# EasyEDA Pro project BCI_nikki_corp_ver_1.0.eprj, board BCI_Board (continued)
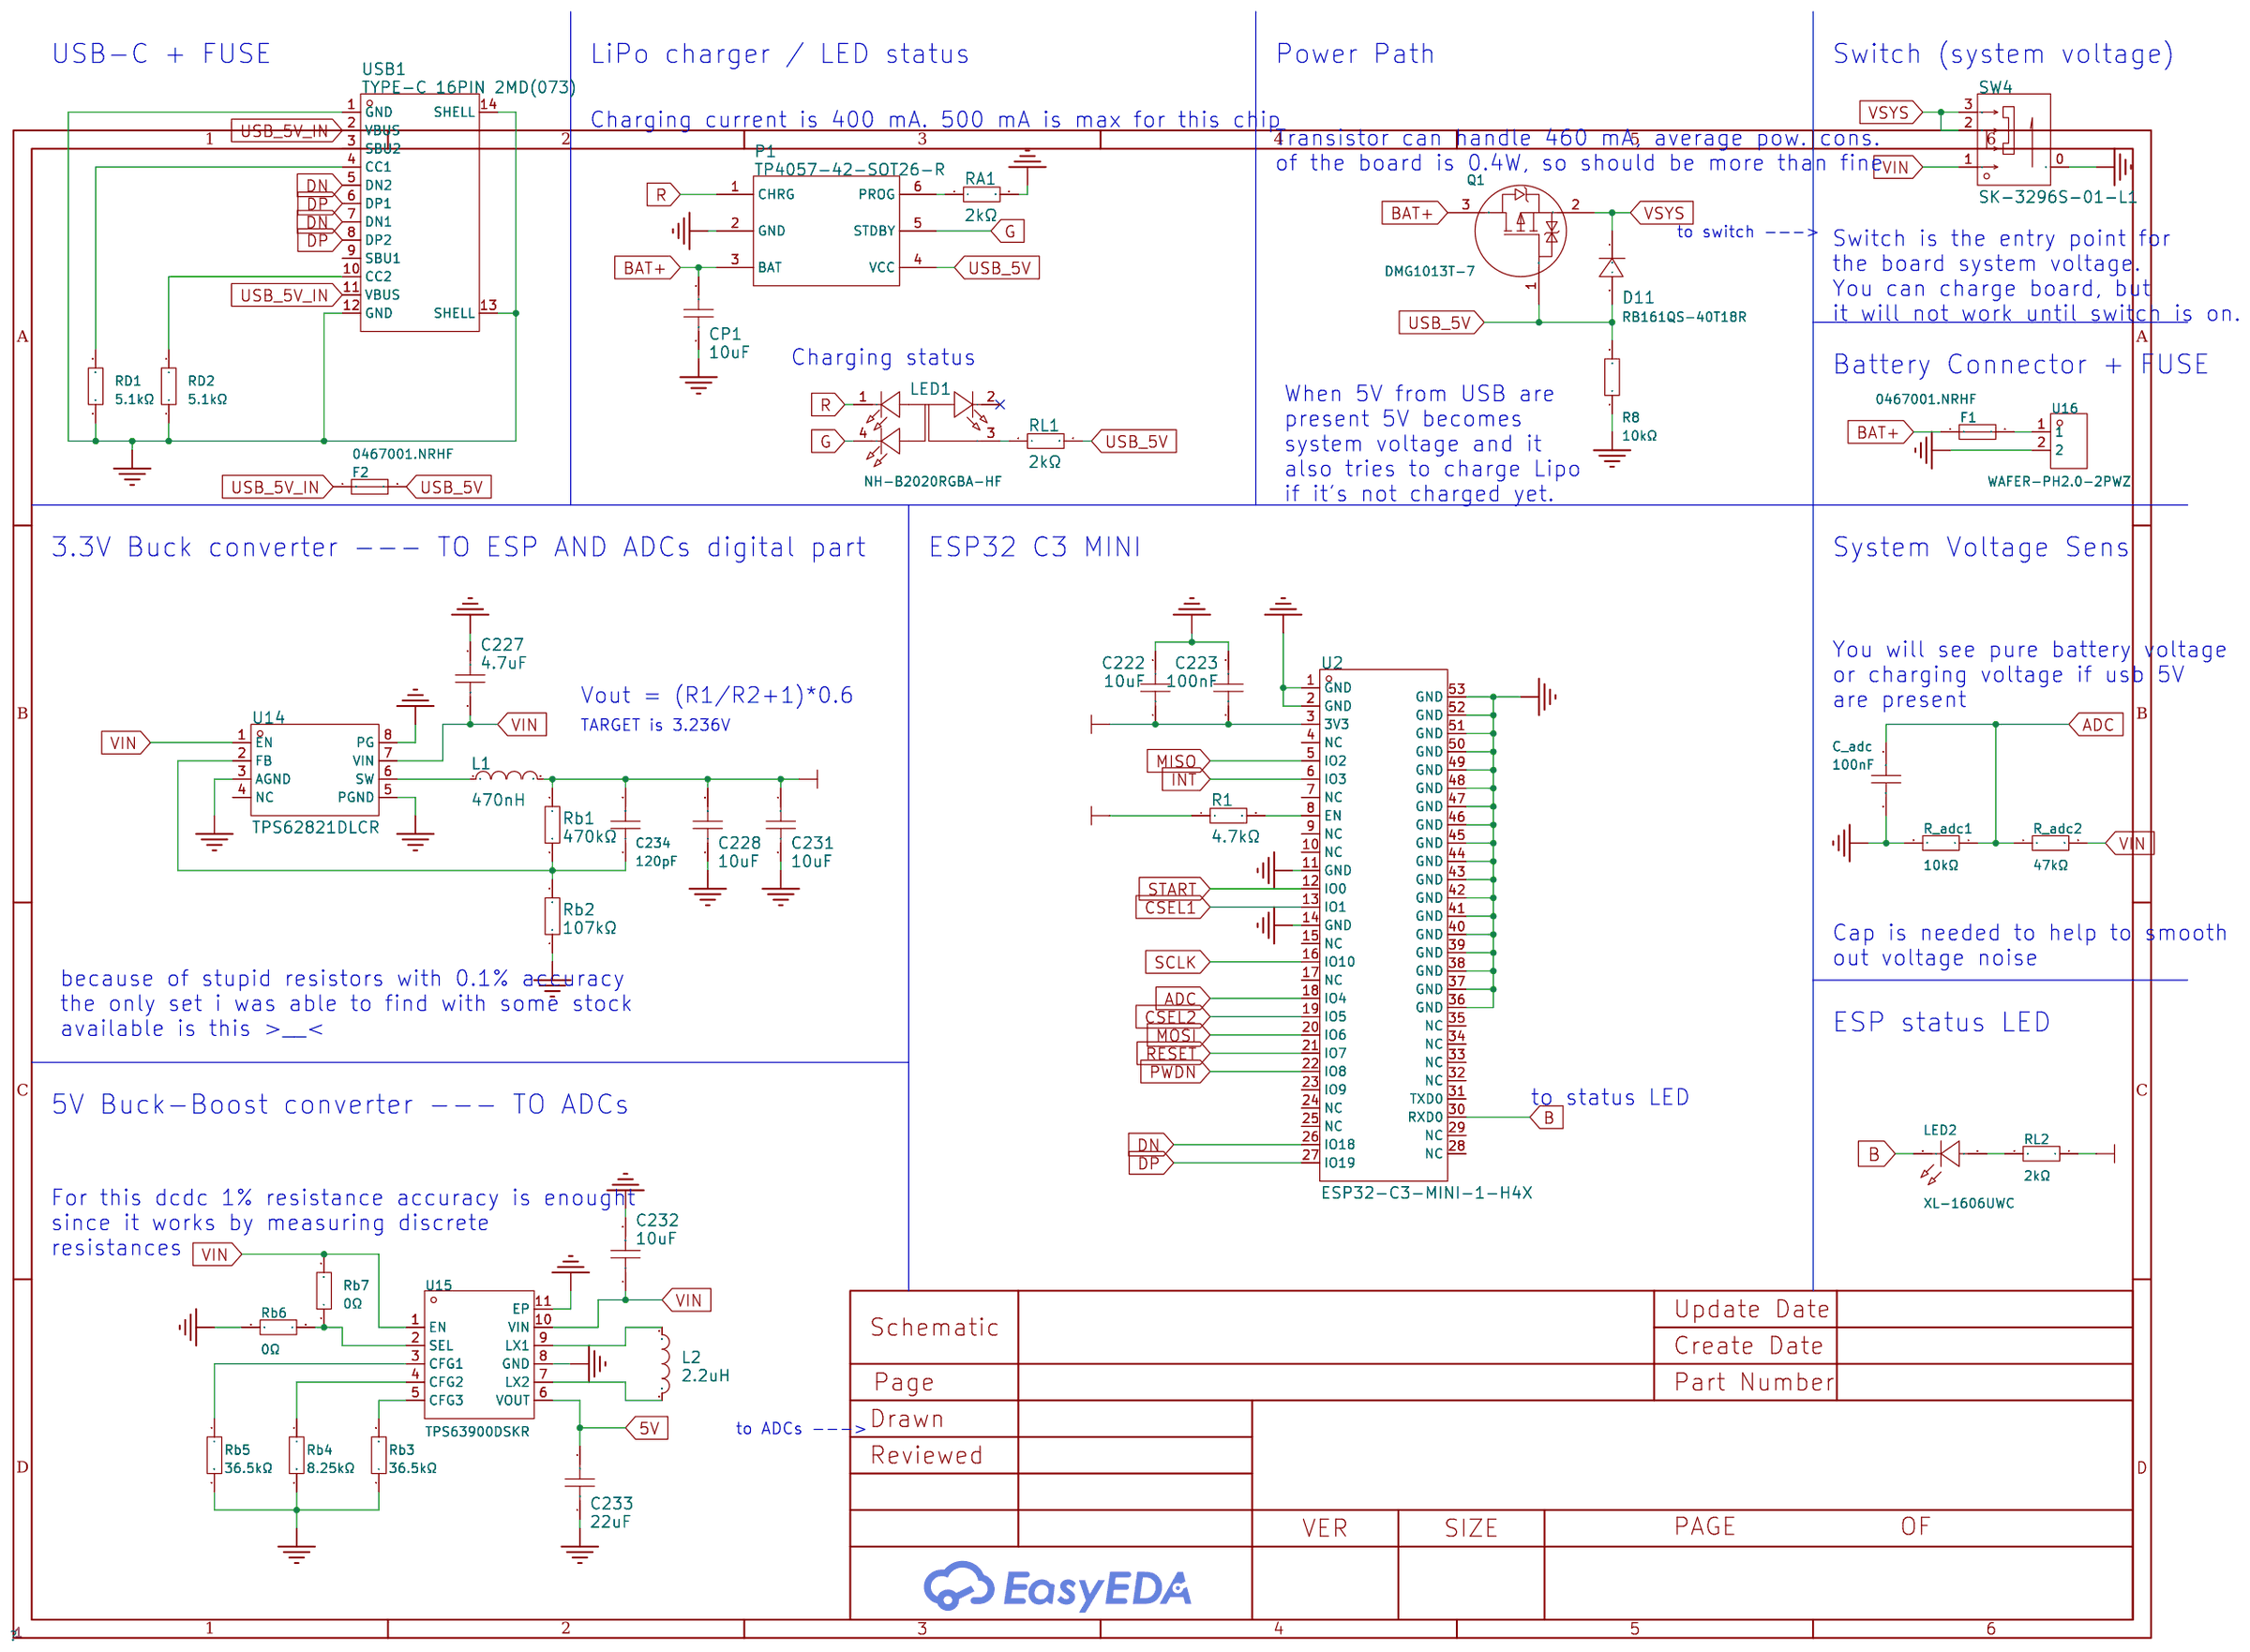
[diagram p0: ESP and Power]
## Copper pours and planes (outline as drawn; the poured copper is in the pictures) (continued)
3V3 on Top Layer: 39.53,4.74 44.33,4.74 44.33,3.11 39.53,3.11
3V3 on Top Layer: 33,37.5 31.89,37.5 31.54,37.85 28.5,37.85 28.5,38.85 31.57,38.85 31.57,38.6 32.02,38.15 33,38.15
3V3 on Top Layer: 38.47,4.49 38.49,4.59 38.55,4.67 38.63,4.72 38.72,4.74 39.9,4.74 40,4.72 40.08,4.67 40.13,4.59 40.15,4.49 40.15,3.36 40.13,3.26 40.08,3.18 40,3.12 39.9,3.11 38.72,3.11 38.63,3.12 38.55,3.18 38.49,3.26 38.47,3.36
3V3 on Top Layer: 26.2,16.95 26.21,17.06 26.26,17.19 26.35,17.3 26.46,17.39 26.59,17.44 26.7,17.45 28.6,17.45 28.71,17.44 28.84,17.39 28.95,17.3 29.04,17.19 29.09,17.06 29.1,16.95 29.1,16.45 29.09,16.34 29.04,16.21 28.95,16.1 28.84,16.01 28.71,15.96 28.6,15.95 26.7,15.95 26.59,15.96 26.46,16.01 26.35,16.1 26.26,16.21 26.21,16.34 26.2,16.45
3V3 on Bottom Layer: 26.3,38.45 26.32,38.55 26.37,38.63 26.45,38.68 26.55,38.7 28.5,38.7 28.6,38.68 28.68,38.63 28.73,38.55 28.75,38.45 28.75,37.9 28.73,37.8 28.68,37.72 28.6,37.67 28.5,37.65 26.55,37.65 26.45,37.67 26.37,37.72 26.32,37.8 26.3,37.9
3V3 on Bottom Layer: 38.5,4.5 38.52,4.6 38.57,4.68 38.65,4.73 38.75,4.75 39.55,4.75 39.65,4.73 39.73,4.68 39.78,4.6 39.8,4.5 39.8,3.4 39.78,3.3 39.73,3.22 39.65,3.17 39.55,3.15 38.75,3.15 38.65,3.17 38.57,3.22 38.52,3.3 38.5,3.4
3V3 on Bottom Layer: 26.34,17.06 26.34,16.85 27.05,16.14 27.39,16.14 28.11,16.86 28.11,17.06 27.97,17.2 26.48,17.2
3V3 on Inner1: 26.3,38.45 26.32,38.55 26.37,38.63 26.45,38.68 26.55,38.7 28.5,38.7 28.6,38.68 28.68,38.63 28.73,38.55 28.75,38.45 28.75,37.9 28.73,37.8 28.68,37.72 28.6,37.67 28.5,37.65 26.55,37.65 26.45,37.67 26.37,37.72 26.32,37.8 26.3,37.9
3V3 on Inner1: 38.5,4.5 38.52,4.6 38.57,4.68 38.65,4.73 38.75,4.75 39.55,4.75 39.65,4.73 39.73,4.68 39.78,4.6 39.8,4.5 39.8,3.4 39.78,3.3 39.73,3.22 39.65,3.17 39.55,3.15 38.75,3.15 38.65,3.17 38.57,3.22 38.52,3.3 38.5,3.4
3V3 on Inner1: 26.34,17.06 26.34,16.85 27.05,16.14 27.39,16.14 28.11,16.86 28.11,17.06 27.97,17.2 26.48,17.2
3V3 on Inner2: 39.9,4.45 39.9,3.2 38.6,3.2 33.65,8.15 31.65,8.15 30.4,6.9 26.82,6.9 26.1,7.62 26.1,17.3 27.51,17.3 27.97,16.85 27.58,16.46 27.58,8.77 28,8.35 29,8.35 30.5,9.85 34.5,9.85
3V3 on Inner2: 26.1,16.95 26.11,17.06 26.16,17.19 26.25,17.3 26.36,17.39 26.49,17.44 26.6,17.45 27.7,17.45 27.81,17.44 27.94,17.39 28.05,17.3 28.14,17.19 28.19,17.06 28.2,16.95 28.2,16.45 28.19,16.34 28.14,16.21 28.05,16.1 27.94,16.01 27.81,15.96 27.7,15.95 26.6,15.95 26.49,15.96 26.36,16.01 26.25,16.1 26.16,16.21 26.11,16.34 26.1,16.45
3V3 on Inner2: 26.1,38.45 26.11,38.56 26.16,38.69 26.25,38.8 26.36,38.89 26.49,38.94 26.6,38.95 28.35,38.95 28.46,38.94 28.59,38.89 28.7,38.8 28.79,38.69 28.84,38.56 28.85,38.45 28.85,37.95 28.84,37.84 28.79,37.71 28.7,37.6 28.59,37.51 28.46,37.46 28.35,37.45 26.6,37.45 26.49,37.46 26.36,37.51 26.25,37.6 26.16,37.71 26.11,37.84 26.1,37.95
5V on Top Layer: 29.5,4 28.24,4 27.4,4.84 26.25,4.84 26.1,4.99 26.1,5.86 26.33,6.09 27.6,6.09 28.9,4.79 29.5,4.79
5V on Bottom Layer: 26.1,6.05 27.8,6.05 27.8,4.85 26.1,4.85
5V on Inner1: 26.1,6.05 27.8,6.05 27.8,4.85 26.1,4.85
5V on Inner2: 22.79,4.8 19.94,7.65 21.59,9.3 24.63,6.26 27.51,6.26 27.81,5.96 27.81,4.8
GND on Top Layer: -12.7,61.6 56.55,61.6 56.55,-10.75 -12.7,-10.75
GND on Bottom Layer: -16.25,59.05 58,59.05 58,-15.9 -16.25,-15.9
GND on Inner1: -14.6,60.57 56.45,60.57 56.45,-13.13 -14.6,-13.13
GND on Inner2: -10.45,63.15 54.45,63.15 54.45,-13.25 -10.45,-13.25
VIN on Top Layer: 41.6,11.25 41.6,12.4 36.91,12.4 33.85,9.34 33.85,5.69 32.95,4.79 32.5,4.79 32.3,4.59 32.3,4.14 32.44,4 34.41,4 35.45,5.04 35.45,8.04 38.65,11.25
VIN on Top Layer: 41.3,7.32 44.03,7.32 44.15,7.45 44.15,8.95 44,9.1 43.45,9.1 41.94,7.59 41.3,7.59
VIN on Top Layer: 40.64,13.55 42.14,13.55 42.14,11.25 40.64,11.25
VIN on Bottom Layer: 40.69,13.25 40.71,13.35 40.76,13.43 40.84,13.48 40.94,13.5 41.84,13.5 41.94,13.48 42.02,13.43 42.07,13.35 42.09,13.25 42.09,12.45 42.07,12.35 42.02,12.27 41.94,12.22 41.84,12.2 40.94,12.2 40.84,12.22 40.76,12.27 40.71,12.35 40.69,12.45
VIN on Bottom Layer: 42.95,8.85 42.97,8.95 43.02,9.03 43.1,9.08 43.2,9.1 43.9,9.1 44,9.08 44.08,9.03 44.13,8.95 44.15,8.85 44.15,7.55 44.13,7.45 44.08,7.37 44,7.32 43.9,7.3 43.2,7.3 43.1,7.32 43.02,7.37 42.97,7.45 42.95,7.55
VIN on Inner1: 40.69,13.25 40.71,13.35 40.76,13.43 40.84,13.48 40.94,13.5 41.84,13.5 41.94,13.48 42.02,13.43 42.07,13.35 42.09,13.25 42.09,12.45 42.07,12.35 42.02,12.27 41.94,12.22 41.84,12.2 40.94,12.2 40.84,12.22 40.76,12.27 40.71,12.35 40.69,12.45
VIN on Inner1: 42.95,8.85 42.97,8.95 43.02,9.03 43.1,9.08 43.2,9.1 43.9,9.1 44,9.08 44.08,9.03 44.13,8.95 44.15,8.85 44.15,7.55 44.13,7.45 44.08,7.37 44,7.32 43.9,7.3 43.2,7.3 43.1,7.32 43.02,7.37 42.97,7.45 42.95,7.55
VIN on Inner2: 40.45,11.85 42.8,9.5 42.8,7.3 44.2,7.3 44.2,10.2 42.25,12.15 42.25,13.55 40.45,13.55
BAT+ on Top Layer: 36.57,19.15 36.58,19.23 36.62,19.29 36.69,19.33 36.77,19.35 38.14,19.35 38.22,19.33 38.28,19.29 38.32,19.23 38.34,19.15 38.34,17.25 38.32,17.17 38.28,17.11 38.22,17.07 38.14,17.05 36.77,17.05 36.69,17.07 36.62,17.11 36.58,17.17 36.57,17.25
BAT+ on Top Layer: 36.2,22.69 36.2,20.42 36.57,20.06 36.57,18.78 36.65,18.69 38.2,18.69 38.2,19.29 37.7,19.79 37.7,21.19 37.1,21.79 37.1,22.69
BAT+ on Top Layer: 36.57,20.65 36.57,17.4 38.34,17.4 38.34,19.7 37.42,20.65
USB_5V on Top Layer: 35.38,26.09 35.4,26.18 35.45,26.27 35.53,26.32 35.63,26.34 36.2,26.34 36.3,26.32 36.38,26.27 36.43,26.18 36.45,26.09 36.45,24.1 36.43,24 36.38,23.92 36.3,23.87 36.2,23.85 35.63,23.85 35.53,23.87 35.45,23.92 35.4,24 35.38,24.1
USB_5V on Top Layer: 34.35,19.93 34.37,20.02 34.43,20.1 34.51,20.16 34.6,20.18 36.07,20.18 36.16,20.16 36.25,20.1 36.3,20.02 36.32,19.93 36.32,19.22 36.3,19.12 36.25,19.04 36.16,18.99 36.07,18.97 34.6,18.97 34.51,18.99 34.43,19.04 34.37,19.12 34.35,19.22
USB_5V on Top Layer: 36.05,24.75 36.07,24.85 36.12,24.93 36.2,24.98 36.3,25 37.5,25 37.6,24.98 37.68,24.93 37.73,24.85 37.75,24.75 37.75,24.1 37.73,24 37.68,23.92 37.6,23.87 37.5,23.85 36.3,23.85 36.2,23.87 36.12,23.92 36.07,24 36.05,24.1
USB_5V on Top Layer: 37.23,23.85 37.23,24.88 36.45,25.66 36.45,26.35 35.38,26.35 35.38,25.65 36.05,25 36.05,23.85
USB_5V on Bottom Layer: 36.6,24.75 36.62,24.85 36.67,24.93 36.75,24.98 36.85,25 37.55,25 37.65,24.98 37.73,24.93 37.78,24.85 37.8,24.75 37.8,24.05 37.78,23.95 37.73,23.87 37.65,23.82 37.55,23.8 36.85,23.8 36.75,23.82 36.67,23.87 36.62,23.95 36.6,24.05
USB_5V on Bottom Layer: 34.35,19.93 34.37,20.02 34.43,20.1 34.51,20.16 34.6,20.18 36.06,20.18 36.16,20.16 36.24,20.1 36.29,20.02 36.31,19.93 36.31,19.22 36.29,19.12 36.24,19.04 36.16,18.99 36.06,18.97 34.6,18.97 34.51,18.99 34.43,19.04 34.37,19.12 34.35,19.22
USB_5V on Inner1: 34.35,19.93 34.37,20.02 34.43,20.1 34.51,20.16 34.6,20.18 36.06,20.18 36.16,20.16 36.24,20.1 36.29,20.02 36.31,19.93 36.31,19.22 36.29,19.12 36.24,19.04 36.16,18.99 36.06,18.97 34.6,18.97 34.51,18.99 34.43,19.04 34.37,19.12 34.35,19.22
USB_5V on Inner1: 36.6,24.75 36.62,24.85 36.67,24.93 36.75,24.98 36.85,25 37.55,25 37.65,24.98 37.73,24.93 37.78,24.85 37.8,24.75 37.8,24.05 37.78,23.95 37.73,23.87 37.65,23.82 37.55,23.8 36.85,23.8 36.75,23.82 36.67,23.87 36.62,23.95 36.6,24.05
USB_5V on Inner2: 36.52,24.04 37.1,23.46 37.1,22.3 34.74,19.94 34.74,19.48 35.25,18.97 36.25,18.97 37.8,20.52 37.8,21.47 38.75,22.42 38.75,24.2 37.88,25.07 36.74,25.07 36.52,24.85
USB_5V on Inner2: 34.35,19.93 34.37,20.02 34.43,20.1 34.51,20.16 34.6,20.18 36.06,20.18 36.16,20.16 36.24,20.1 36.29,20.02 36.31,19.93 36.31,19.22 36.29,19.12 36.24,19.04 36.16,18.99 36.06,18.97 34.6,18.97 34.51,18.99 34.43,19.04 34.37,19.12 34.35,19.22
USB_5V on Inner2: 37.23,23.15 36.83,22.75 36.55,22.75 35.85,22.05 35.85,20.75 36.27,20.33 37.55,21.6 37.55,22.95 37.35,23.15
USB_5V_IN on Top Layer: 39.92,25.48 37.15,25.48 37.15,26.38 38.35,26.38 38.7,26.03 39.92,26.03
USB_5V_IN on Inner2: 37.8,26.16 37.8,25.8 39.24,24.36 39.24,22.37 38.15,21.28 38.15,20.7 38.4,20.45 39.2,20.45 40.7,21.95 40.7,24.8 39.2,26.3 37.94,26.3
VSYS on Top Layer: 34.35,18.42 34.37,18.51 34.43,18.59 34.51,18.65 34.6,18.67 36.07,18.67 36.16,18.65 36.24,18.59 36.3,18.51 36.32,18.42 36.32,16.61 36.3,16.51 36.24,16.43 36.16,16.38 36.07,16.36 34.6,16.36 34.51,16.38 34.43,16.43 34.37,16.51 34.35,16.61
VSYS on Top Layer: 39.54,16.75 42.09,16.75 42.09,14.25 39.54,14.25
VSYS on Bottom Layer: 34.35,18.01 34.37,18.1 34.42,18.19 34.5,18.24 34.6,18.26 36.06,18.26 36.16,18.24 36.24,18.19 36.29,18.1 36.31,18.01 36.31,16.61 36.29,16.51 36.24,16.43 36.16,16.38 36.06,16.36 34.6,16.36 34.5,16.38 34.42,16.43 34.37,16.51 34.35,16.61
VSYS on Bottom Layer: 39.55,16.75 40.8,16.75 40.8,14.25 39.55,14.25
VSYS on Inner1: 34.35,18.01 34.37,18.1 34.42,18.19 34.5,18.24 34.6,18.26 36.06,18.26 36.16,18.24 36.24,18.19 36.29,18.1 36.31,18.01 36.31,16.61 36.29,16.51 36.24,16.43 36.16,16.38 36.06,16.36 34.6,16.36 34.5,16.38 34.42,16.43 34.37,16.51 34.35,16.61
VSYS on Inner1: 39.55,16.75 40.8,16.75 40.8,14.25 39.55,14.25
VSYS on Inner2: 34.35,18.01 34.37,18.1 34.43,18.19 34.51,18.24 34.6,18.26 36.06,18.26 36.16,18.24 36.24,18.19 36.29,18.1 36.31,18.01 36.31,16.61 36.29,16.51 36.24,16.43 36.16,16.38 36.06,16.36 34.6,16.36 34.51,16.38 34.43,16.43 34.37,16.51 34.35,16.61
VSYS on Inner2: 35.7,16.36 38.7,16.36 39.65,15.41 40.4,15.41 40.79,15.8 40.79,16.72 39.25,18.26 35.7,18.26
VSYS on Inner2: 39.54,16.75 40.79,16.75 40.79,14.25 39.54,14.25
$1N290221 on Top Layer: 41.3,7.08 42.93,7.08 43.25,6.75 43.25,5.9 42.95,5.6 42.3,5.6 42.2,5.7 42.2,6.55 41.94,6.81 41.3,6.81
$1N381046 on Top Layer: 31.26,4.68 31.26,2.18 32.38,3.3 32.38,3.4 31.56,4.23 31.56,4.68
$1N381052 on Top Layer: 30.54,4.68 30.54,2.18 29.41,3.3 29.41,3.4 30.24,4.23 30.24,4.68
$1N406824 on Top Layer: 36.57,16.1 36.58,16.2 36.64,16.28 36.72,16.33 36.82,16.35 38.09,16.35 38.19,16.33 38.27,16.28 38.32,16.2 38.34,16.1 38.34,13.5 38.32,13.4 38.27,13.32 38.19,13.27 38.09,13.25 36.82,13.25 36.72,13.27 36.64,13.32 36.58,13.4 36.57,13.5

Small or netless copper shapes (teardrops, artwork), in the pictures only: 3 on Top Layer, 1 on Bottom Layer, 1 on Inner1

## Text on the board
Bottom Silkscreen Layer: l lll l llll ll l | SRB2 | G | SRB2--- | BIAS drive / MASTERout | BIAS drive / SLAVEin | 5V | V1.0 | 5V dcdc out | CLKtoSLAVE | 3V3 ESPin | SLAVE DOUT | INT | SCLK | RESET | MOSI | MISO | espLED | CSEL1 | 3V3 | CSEL2 | VSYS | DN | = | BIAS | N8 | N7 | N6 | N5 | N4 | N3 | N2 | N1 | S2 | N16 | N15 | N14 | N13 | N12 | N11 | N10 | N9 | P8 | P7 | P6 | P5 | P4 | P3 | P2 | P1 | S1 | P16 | P15 | P14 | P13 | P12 | P11 | P10 | P9 | PWDN | DP | BAT / SENSE | SRB1--- | USB5V | designed / by nikki
